# EasyEDA Pro project PRO_project.eprj, board PCB1_1 (continued)
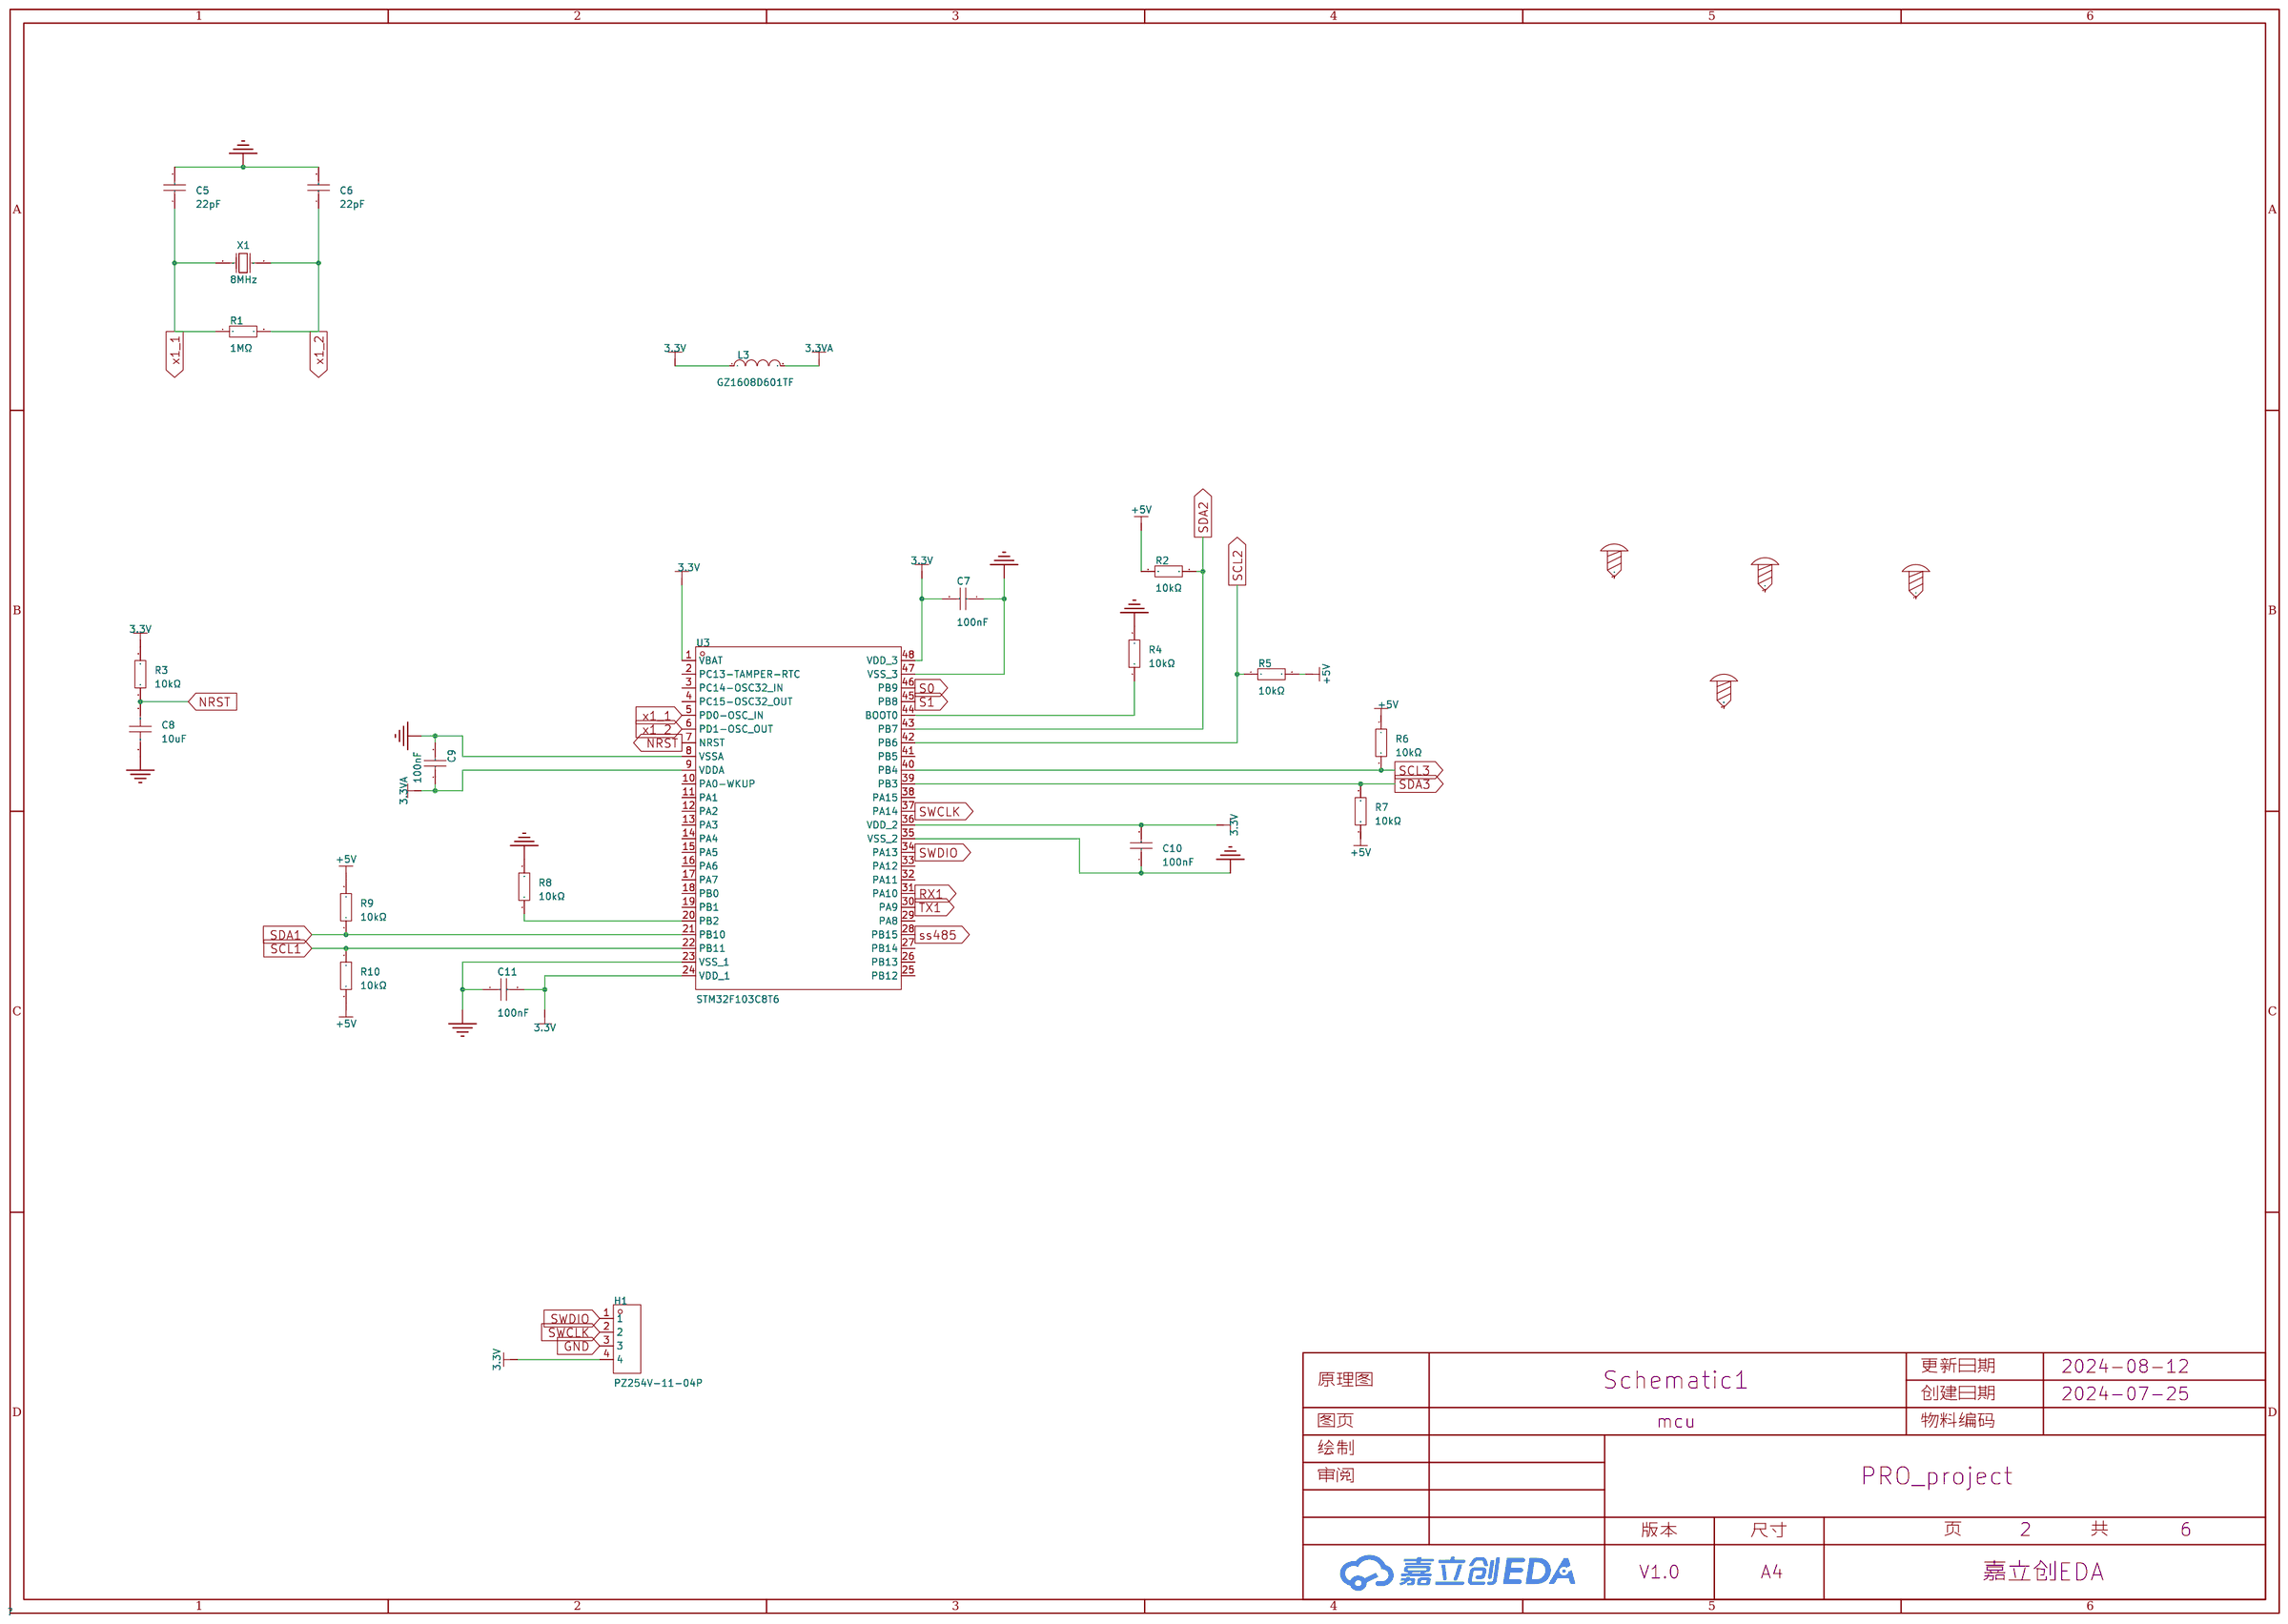
[diagram p0: mcu]
## Routing (per net, layer and track width the routed paths; a pad name or vN(x,y) marks a point on that pad's centre or on a via; arc(x,y) is an arc through that point) (continued)
  Top Layer w0.762: 29.47,14.94 L2.2 29.47,27.43 ; 29.47,14.94 29.47,9.52 30.08,8.91 v1(31.84,8.91) v1(32.82,8.91) ; 29.47,14.94 30.24,14.18 37.93,14.18 U34.2 ; 29.47,27.43 34.4,27.43 U2.3 ; 29.47,27.43 29.47,31.14 28.84,31.77 C3.1 27.2,33.87 25.42,35.65 15.18,35.65 U1.4 ; v1(3.86,52.98) 3.9,52.94 C20.2
  Inner2 w0.762: U9.2 33.47,59.42 46.32,59.42 U11.2 ; U19.2 103.51,59.55 91.17,59.55 U18.2 ; v1(39.33,50.83) 38.38,50.83 v1(34.64,47.09) 34.64,46.99 v1(32.69,45.04) ; U16.2 75.5,59.82 63.68,59.82 U17.2
  Bottom Layer w0.254: 102.99,50.29 115.29,50.29 v1(115.49,50.09) ; 102.99,50.29 103.03,50.25 v1(103.03,40.53) ; 102.99,50.29 83.41,50.29 82.73,49.61 v1(82.73,47.38) 82.69,47.38 82.66,47.35 ; v1(14.05,47.08) 14.1,47.03 14.17,47.03 14.17,52.34 v1(12.9,53.61) ; v1(115.49,42.32) 115.52,42.32 ; 32.79,45.24 v1(34.64,47.09) ; v1(71.06,51.47) 71.04,51.49 69.59,51.49 69.06,50.96 69.06,50.03 v1(69.16,49.93) 69.1,49.93
  Bottom Layer w0.508: v1(115.47,47.4) 115.49,47.38 v1(115.49,42.32)
  Bottom Layer w0.762: 67.63,27.99 67.84,27.78 U26.2 75.52,27.26 U25.2 102.64,27.26 U24.2 116.17,27.6 U27.2 ; 67.63,27.99 v1(67.63,29.17) ; 67.63,27.99 67.63,13.15 63.43,8.95 30.99,8.95 ; 2.14,53.01 2.14,57.71 3.18,58.75 U8.2 U10.2 U9.2 ; 2.14,53.01 2.17,52.98 v1(3.86,52.98) ; 2.14,53.01 2.14,49.8 15.03,36.91 22.06,36.91 C3.1 ; U16.2 U18.2 ; U11.2 U17.2
GND: length 621.3
  Top Layer w0.254: 106.1,46.46 106.1,48.32 v1(105.67,48.75) ; 106.1,46.46 U32.8 ; 106.1,46.46 U32.6 ; C44.1 102.53,33.75 U20.5 ; C48.2 11.27,49.45 v1(11.27,50.34) ; v1(41.93,34) 43.05,32.88 C11.1 43.74,33.32 43.74,33.71 44.11,34.08 44.11,34.11 ; 42.67,45.93 42.76,45.84 42.76,44.02 43.81,42.97 C9.2 ; 42.67,45.93 39.98,45.93 v1(38.99,46.91) C49.2 ; 42.67,45.93 44.44,47.7 ; v1(66.41,49.42) 67.21,48.62 C51.2 ; v1(97.92,41.48) 98.18,41.22 99.78,41.22 ; v1(27.2,37.31) 30.33,37.31 32.69,39.67 U29.2 ; v1(27.2,37.31) 26.28,37.31 23.13,40.46 U28.7 ; v1(27.2,37.31) 27.13,37.24 ; U23.5 115.78,33.14 C47.1 ; U38.3 61.68,12.67 61.64,12.71 v1(60.27,12.71) ; C50.2 87.67,46.61 v1(87.89,46.39) ; v1(51.58,43.87) 51.08,44.37 49.27,44.37 47.92,45.72 v1(47.92,46.4) 47.92,48.06 v1(48.74,48.88) 48.74,51.38 49.07,51.71 57.52,51.71 58.24,50.99 v1(58.24,47.21) 58.24,45.54 v1(57.26,44.56) 56.18,44.56 55.59,43.97 55.59,42.95 54.69,42.05 v1(54.25,42.05) ; C4.2 43.24,26.54 v1(43.87,25.91) ; R3.2 60.57,40.4 v1(60.33,40.64) 58.75,40.64 C7.1 ; C53.2 116.06,39.74 v1(115.37,39.06) ; C22.1 20.29,53.75 U6.5 ; v1(101.49,48.25) 101.07,47.83 U33.2 ; 44.44,47.7 43.75,47.7 42.92,48.53 v1(42.87,48.53) ; 44.44,47.7 C8.1 ; v1(48.03,43.59) 48.03,43.42 48.38,43.07 50.54,43.07 51.82,41.79 U3.8 51.82,39.35 52.4,38.77 56.81,38.77 U3.47 ; U22.5 74.46,33.65 C45.1 ; C35.1 105.79,54 U15.5 ; C46.1 87.71,33.08 U21.5 ; C21.1 35.31,55.86 U5.5 ; C23.1 46.4,51.96 45.2,50.76 v1(43.56,50.76) ; U13.5 65.5,56.54 C33.1 61.95,52.88 v1(61.95,50.6) ; U28.8 24.28,42.71 22.18,42.71 ; U31.2 85.08,40.63 84.9,40.45 81.01,40.45 v1(79.99,41.47) 79.36,42.1 U30.8 U30.7 U30.6 ; 2.21,50.36 2.23,50.34 v1(6.99,50.34) ; U3.23 53.57,34.27 53.57,34.28 v1(54.81,34.28) 54.81,33.38 54.82,33.38 U3.35 ; H2.3 62.27,32.33 62.09,32.52
  Top Layer w0.508: C47.1 116.62,33.12 U27.1 ; U13.5 64.95,56.21 U17.1 ; U11.1 49.47,56.21 U7.5 ; U25.1 89.52,30.06 C46.1 ; U14.5 91.96,56.21 U18.1 ; U24.1 102.72,30.4 C44.1 ; U5.5 35.16,56.21 U9.1 ; U10.1 21.23,56.21 U6.5 ; U4.5 7.87,56.21 U8.1 ; U12.5 79.04,56.21 76.68,56.21 ; U19.1 106.46,56.21 U15.5 ; C45.1 74.92,30.4 U26.1
  Top Layer w0.762: v1(53.42,51.77) 53.42,50.54 53.17,50.29 ; 53.17,50.29 54.55,50.29 C5.2 ; 53.17,50.29 C6.2 ; U1.6 4.84,33.75 C1.2 ; U1.6 2.21,36.38 2.21,55.17 3.25,56.21 U8.1 ; U1.6 v1(8.15,37.24) U1.5 27.17,37.24 32.5,31.91 U2.1 ; U1.6 v1(8.5,33.84) U1.3 ; C54.2 37.03,12.54 U34.1 ; C32.1 77.77,53.41 77.77,55.12 76.68,56.21 U16.1 ; CN1.2 13.7,11.19 D2.1 ; 13.39,10.98 D2.1 ; D2.1 15.36,11.24 16.34,12.22 D3.1 ; U18.1 91.31,55.27 91.31,53.8 C34.1
  Inner1 w0.762: U26.1 77.21,32.53 86.53,32.53 U25.1 91.08,31.62 101.5,31.62 U24.1 104.73,31.89 115.24,31.89 116.62,30.51 U27.1 120.11,33.18 v1(120.11,33.49) v1(120.11,42.54) 120.11,50.22 v1(118.09,52.24) 114.12,56.21 U19.1 102.16,54.06 92.52,54.06 U18.1 86.72,52.56 80.22,52.56 U16.1 73.4,53.04 65.78,53.04 U17.1 61.56,55.16 48.04,55.16 U11.1 44.83,54.05 43.53,54.05 41.37,56.21 U9.1 30.99,54.4 20.91,54.4 U10.1 19.01,56.3 10.4,56.3 8.46,54.36 7.31,54.36 U8.1 5.46,39.93 v1(8.15,37.24) 8.15,29.21 v1(7.95,29.01) 7.95,22.75 C1.2 4.84,12.92 CN1.2
  Bottom Layer w0.254: v1(105.67,48.75) 105.62,48.75 105.58,48.71 ; v1(115.37,39.06) 115.37,39.07 ; v1(43.56,50.76) 42.92,50.12 42.92,48.6 42.87,48.55 v1(42.87,48.53) 43.48,48.53 48.03,43.98 v1(48.03,43.59) ; v1(66.41,49.42) 66.39,49.44 ; v1(87.89,46.39) 87.88,46.39 ; v1(11.27,50.34) v1(6.99,50.34)
  Bottom Layer w0.762: U26.1 71.22,30.32 v1(68.45,33.09) ; v1(61.95,50.6) 62.61,51.26 U17.1
  vias: v1(1.18,29.01) v1(1.53,38.14) v1(10.46,51.99) v1(32.44,49) v1(59.27,22.33) v1(59.89,18.39) v1(60.57,28.37) v1(80.03,33.54) v1(90.39,36.01) v1(101.19,44.23) v1(111.18,43.17) v1(113.64,52.24) v1(120.16,36.64) v1(120.28,47.19)
1N0: length 35.3
  Top Layer w0.254: 15.51,42.59 15.51,44.36 v1(15.4,44.47) ; 36.78,55.86 36.78,54 36.63,53.86 v1(36.56,53.86)
  Bottom Layer w0.254: v1(15.4,44.47) 15.35,44.47 15.35,53.93 15.92,54.5 35.92,54.5 v1(36.56,53.86)
1N1: length 25.5
  Top Layer w0.254: v1(23.35,53.51) 23.35,55.35 U6.6 ; v1(20.64,39.98) 20.62,39.98 20.62,42.56 20.59,42.59
  Bottom Layer w0.254: v1(23.35,53.51) 22.86,53.02 19.47,53.02 17.82,51.37 17.82,40.41 18.91,39.32 19.98,39.32 v1(20.64,39.98)
1N2: length 18.3
  Top Layer w0.254: 9.2,56.15 9.2,49.75 13.31,45.64 15.98,45.64 16.78,44.84 U28.2
1N3: length 46.6
  Top Layer w0.254: U7.6 50.96,55.36 v1(49.15,53.56) ; v1(19.29,40.57) 19.32,40.59 U28.4
  Bottom Layer w0.254: v1(49.15,53.56) 47.28,51.69 19.98,51.69 19.29,51 v1(19.29,40.57)
1P0: length 23.6
  Top Layer w0.254: 20.59,48.06 20.59,49.98 21.6,51 36.22,51 38.07,52.85 38.07,55.83 U5.7
1P1: length 13.1
  Top Layer w0.254: U6.7 24.6,55.37 24.6,52 24.35,51.75 19.34,51.75 18.05,50.45 U28.14
1P2: length 11.8
  Top Layer w0.254: U4.7 10.47,53.97 14.31,50.13 16.24,50.13 16.78,49.59 U28.15
1P3: length 34.7
  Top Layer w0.254: U7.7 52.23,55.63 46.48,49.89 22.18,49.89 21.86,49.56 U28.11
1ZN: length 17.5
  Top Layer w0.254: U28.3 18.05,44 18.36,44.32 28.98,44.32 29.73,43.57 29.73,42.07 30.81,40.99 U29.1
1ZP: length 16
  Top Layer w0.254: U28.13 19.32,46.04 19.97,45.39 31,45.39 31.74,44.65 U29.6
2N0: length 40
  Top Layer w0.254: U30.1 68.83,42.1 v1(67.9,43.03) ; U14.6 94.67,54.76 94.67,52.98 94.19,52.5 v1(93.54,52.5)
  Bottom Layer w0.254: v1(67.9,43.03) 67.9,51.7 68.7,52.5 v1(93.54,52.5)
2N1: length 43.5
  Top Layer w0.254: v1(74.62,39.46) 74.59,39.49 U30.5 ; U12.6 80.77,54.16 v1(80.64,54.04)
  Bottom Layer w0.254: v1(80.64,54.04) 65.14,54.04 64.02,52.92 64.02,43.61 68.57,39.06 74.22,39.06 v1(74.62,39.46)
2N2: length 19.6
  Top Layer w0.254: U13.6 66.77,52.44 65.1,50.78 65.1,46.6 66.15,45.55 69.44,45.55 70.7,44.29 70.7,42.18 U30.2
2N3: length 50.2
  Top Layer w0.254: v1(73.27,40.29) 73.32,40.33 U30.4 ; v1(108.43,53.01) 108.38,53.06 108.38,55.32 U15.6
  Bottom Layer w0.254: v1(108.43,53.01) 107.1,51.67 75.29,51.67 73.27,49.66 v1(73.27,40.29)
2P0: length 27.4
  Top Layer w0.254: U14.7 95.67,54.88 95.67,51.53 95.1,50.96 75.9,50.96 74.59,49.64 U30.12
2P1: length 16.5
  Top Layer w0.254: U30.14 72.05,50.47 73.21,51.64 80.31,51.64 82.04,53.36 82.04,55.75
2P2: length 10.3
  Top Layer w0.254: 68.04,56.75 68.04,52.92 70.78,50.18 U30.15
2P3: length 40.8
  Top Layer w0.254: U30.11 75.86,49.48 76.73,50.36 109.04,50.36 109.74,51.06 109.74,55.41 U15.7
2ZN: length 14.4
  Top Layer w0.254: U31.1 84.09,42.58 84.09,43.21 83.54,43.76 72.49,43.76 72.05,43.31 U30.3
2ZP: length 13.1
  Top Layer w0.254: U31.6 83.55,44.66 74.81,44.66 73.32,46.15 U30.13
3N0: length 42.8
  Top Layer w0.254: U21.6 84.64,31.45 v1(84.64,33.61) ; v1(114.2,44.72) 113.72,45.2 U32.1
  Bottom Layer w0.254: v1(114.2,44.72) 114.2,37.16 111.18,34.14 85.17,34.14 v1(84.64,33.61)
3N1: length 26.9
  Top Layer w0.254: v1(108.62,48.64) 108.64,48.62 U32.5 ; U20.6 98.75,31.27 98.75,33.36 98.72,33.36 99.8,34.44 v1(99.8,35.33)
  Bottom Layer w0.254: v1(99.8,35.33) 100.99,36.52 106.54,36.52 108.59,38.57 108.59,48.61 v1(108.62,48.64)
3N2: length 21.7
  Top Layer w0.254: U32.2 112.45,44.11 112.7,43.86 116.67,43.86 117.3,43.23 117.3,38.65 112.44,33.78 U23.6
3N3: length 76.1
  Top Layer w0.254: U22.6 70.8,31.35 v1(70.8,33.89) ; v1(109.88,48.84) 109.91,48.81 U32.4
  Bottom Layer w0.254: v1(109.88,48.84) 110.28,49.24 117.29,49.24 118.49,48.04 118.49,36.07 114.73,32.31 72.38,32.31 v1(70.8,33.89)
3P0: length 32.3
  Top Layer w0.254: U21.7 83.46,34.05 83.75,34.35 93.41,34.35 95.65,36.59 106.85,36.59 108.64,38.37 U32.12
3P1: length 21.9
  Top Layer w0.254: U32.14 111.18,37.95 109.14,35.91 98.01,35.91 97.5,35.4 U20.7
3P2: length 10.5
  Top Layer w0.254: U32.15 112.54,40.9 112.54,36.61 111.17,35.23 U23.7
3P3: length 45.5
  Top Layer w0.254: U32.11 107.37,38.34 106.36,37.34 88.38,37.34 86.55,35.51 70.18,35.51 69.58,34.9 U22.7
3ZN: length 11.4
  Top Layer w0.254: U32.3 111.18,44.75 110.95,44.53 103.07,44.53 U33.1
3ZP: length 9.7
  Top Layer w0.254: U33.6 109.63,42.88 109.97,42.54 109.97,41.06 U32.13
485+: length 56.9
  Top Layer w0.254: v1(52.27,11.61) 51.24,12.64 51.19,12.64 R63.2 ; R58.2 35.51,22.62 34.53,23.6 v1(34.51,23.6) ; 42.53,17.54 41.1,17.54 40.55,16.99 R57.1 40.33,16.58 38.07,16.58
  Top Layer w0.381: U37.4 56.7,18.07 57.53,17.24 57.53,10.7 56.96,10.13 53.75,10.13 v1(52.27,11.61)
  Top Layer w0.762: 38.07,16.58 37.99,16.5 31.51,16.5
  Bottom Layer w0.254: 37.36,16.5 34.51,19.35 v1(34.51,23.6) ; 38.07,16.58 39.77,14.88 49,14.88 v1(52.27,11.61)
485-: length 67
  Top Layer w0.254: 38.07,19.12 40.31,21.35 42.53,21.35 ; v1(45.52,25.11) 45.52,27.35 45.69,27.52 47.78,27.52 U36.3 ; R60.1 33.19,24.79 32.45,24.05 32.45,19.4 32.73,19.12
  Top Layer w0.381: v1(50.12,10.46) 49.44,11.14 R55.2
  Top Layer w0.762: 31.51,17.9 32.73,19.12 38.07,19.12
  Bottom Layer w0.254: v1(45.52,25.11) 40.72,25.11 38.07,22.46 38.07,19.12
  Bottom Layer w0.381: v1(50.12,10.46) 50.12,10.49 53.73,10.49 54.7,11.46 54.7,22.18 52.68,24.2 46.43,24.2 v1(45.52,25.11)
DI: length 13.4
  Top Layer w0.254: 47.47,22.62 47.79,22.94 U36.4 ; 47.47,22.62 R58.1 ; 47.47,22.62 47.94,22.15 U35.4
NRST: length 10.6
  Top Layer w0.254: C8.2 46.68,46.32 R2.1 46.83,46.05 49.31,43.57 50.75,43.57 52.32,42 U3.7
RO: length 14.5
  Top Layer w0.254: U35.1 50.04,17.54 51.03,16.55 56,16.55 56.51,16.04 56.51,13.25 55.93,12.67 U38.2
RX1: length 59.3
  Top Layer w0.254: v1(59.63,25.38) 59.63,27.62 58.55,28.7 v1(54.53,28.7) 52.82,30.41 U3.31 ; v1(65.03,25.59) 65.03,25.52 ; 65.03,25.52 R62.2 ; 65.03,25.52 65.88,24.67 65.88,16.22 64.87,15.21 U38.4
  Bottom Layer w0.254: v1(65.03,25.59) 59.84,25.59 v1(59.63,25.38) ; H4.1 33.3,31.46 36.78,27.98 53.81,27.98 v1(54.53,28.7)
S0: length 153.2
  Top Layer w0.254: v1(91.57,47.79) 91.57,49.5 91.43,49.64 77.54,49.64 77.13,49.22 U30.10 77.1,47.55 v1(77.1,45.82) ; v1(46.46,41.05) 43.6,41.05 39.12,45.53 34.7,45.53 33.99,46.24 23.61,46.24 23.13,46.72 U28.10 ; v1(91.08,40.68) 91.13,40.63 91.13,39.32 92.32,38.13 105.39,38.13 106.1,38.83 106.1,40.99 ; v1(50.98,38.59) 51.3,38.27 U3.46 57.86,38.27 v1(58.58,38.99)
  Inner1 w0.254: v1(58.58,38.99) 69.09,38.99 73.55,43.45 90.41,43.45 91.5,44.54 H3.1
  Inner2 w0.762: v1(46.46,41.05) 46.46,40.66 47.7,39.42 50.15,39.42 v1(50.98,38.59)
  Bottom Layer w0.254: v1(91.57,47.79) 91.08,47.3 v1(91.08,40.68) ; v1(58.58,38.99) 65.84,38.99 67.82,37.01 76.04,37.01 77.1,38.07 v1(77.1,45.82)
S1: length 123.4
  Top Layer w0.254: U30.9 78.4,48.57 78.58,48.76 88.84,48.76 89.62,47.98 89.62,45.87 90,45.49 93.98,45.49 94.15,45.32 ; U28.9 39.73,48.06 v1(40.46,47.33) ; v1(94.18,40.9) 96.13,38.95 104.47,38.95 104.83,39.3 U32.9 ; v1(94.18,45.49) 94.18,47.58 H3.2 ; v1(50.39,37.77) U3.45 58.74,37.77 v1(59.12,38.15)
  Inner1 w0.254: H3.2 94.04,43.93 92.74,42.63 89.73,42.63 83.8,36.7 60.57,36.7 v1(59.12,38.15)
  Inner2 w0.762: v1(50.39,37.77) 46.14,37.77 40.46,43.45 v1(40.46,47.33)
  Bottom Layer w0.254: v1(94.18,40.9) v1(94.18,45.49)
SCL1: length 88.7
  Top Layer w0.254: v1(42.52,36.55) 38.08,40.99 U29.3 ; U33.3 100.12,46.54 v1(99.12,47.54) 98.82,47.84 H1.1 ; v1(86.07,40.21) 86.03,40.25 U31.3 ; v1(51.71,35.56) 52.42,36.27 U3.42 60.52,36.27 61,35.79 61.7,35.79 R5.1 62.47,36.56 v1(85.18,36.56)
  Inner2 w0.762: v1(42.52,36.55) 43.51,35.56 v1(51.71,35.56)
  Bottom Layer w0.254: v1(99.12,47.54) 99.12,48.35 97.9,49.57 86.64,49.57 86.07,49 v1(86.07,40.21) 86.07,37.45 v1(85.18,36.56)
SDA1: length 81.1
  Top Layer w0.254: 88.77,43.21 89.1,42.88 97.32,42.88 ; 88.77,43.21 88.77,39.52 86.8,37.55 R4.2 61.19,36.77 U3.43 v1(50.46,36.77) ; 88.77,43.21 v1(88.77,44.55) 88.1,45.22 86.05,45.22 U31.4 ; 97.32,42.88 U33.4 ; 97.32,42.88 97.32,45.21 H1.2 ; U29.4 37.88,43.69 v1(41.53,40.04)
  Inner2 w0.762: v1(50.46,36.77) 44.8,36.77 v1(41.53,40.04)
SS: length 22.4
  Top Layer w0.254: R60.2 44.16,24.79 v1(45.3,23.65) ; U35.3 U35.2 46.23,18.81 v1(45.91,19.13) ; 53.56,20.08 U37.3
  Top Layer w0.381: U35.3 53.56,20.08
  Bottom Layer w0.254: v1(45.91,19.13) 45.91,19.17 45.3,19.78 v1(45.3,23.65)
SS485: length 36.9
  Top Layer w0.254: U37.2 57.24,20.61 51.32,26.53 v1(51.32,30.38) U3.28
  Bottom Layer w0.254: H4.3 38.55,35.57 38.55,32.42 40.59,30.38 v1(51.32,30.38)
SWCLK: length 5.6
  Top Layer w0.254: H2.2 59.75,30.36 59.75,32.51 58.49,33.77 U3.37
SWDIO: length 4.6
  Top Layer w0.254: 57.14,30.12 57.01,30.25 54.84,30.25 54.32,30.77 U3.34
TX1: length 29.7
  Top Layer w0.254: U3.30 52.32,29.54 v1(52.78,29.08) 54.35,27.51 U36.2
  Bottom Layer w0.254: v1(52.78,29.08) 38.91,29.08 36.3,31.69 36.3,35.28 H4.2
X1_1: length 10.9
  Top Layer w0.254: 56.51,50.39 56.51,47.44 X1.2 54.39,45.32 R1.1 53.32,42.16 U3.5
X1_2: length 10.5
  Top Layer w0.254: 49.9,50.04 49.9,47.13 X1.1 52.89,44.15 R1.2 52.82,43.17 U3.6
$1N1353: length 4.6
  Top Layer w0.254: U3.44 60.08,37.27 60.57,37.75 R3.1
$1N1456: length 4.5
  Top Layer w0.254: U3.20 46.94,35.77 46.7,35.53 46.7,34.76 46.22,34.28 45.14,34.28 R6.2
$2N657: length 14.3
  Top Layer w0.762: U1.2 17.54,32.14 19.14,30.54 19.14,26.83 19.09,26.78 19.21,26.66 ; 19.21,26.66 16.81,26.66 D3.2 ; 19.21,26.66 L1.2
$2N1653: length 14.3
  Top Layer w0.762: L2.1 26.87,21.07 25.86,20.06 L1.1 21.75,16 22.25,15.5 24.24,15.5 C2.1
$2N2288: length 10.9
  Top Layer w0.762: CN1.1 18.83,4.19 D2.2 18.91,11.31 D1.2
$2N2289: length 21.7
  Top Layer w0.762: D1.1 9.84,18.77 C1.1 11.7,19.64 12.47,20.41 12.47,29.94 12.97,30.44 U1.1
$3N444: length 5.4
  Top Layer w0.762: R18.1 40.15,71.19 R17.1
$3N877: length 14.7
  Top Layer w0.254: U5.4 35.45,66.81 35.45,67.95 35.06,68.34 C17.1 31.02,68.34 30.76,68.08 30.76,61.8 31.26,61.3 32.79,61.3 U9.3
$3N883: length 11.9
  Top Layer w0.254: C17.2 32.18,64.45 U9.4 34.09,65.12 39.04,65.12 39.32,65.39 U5.1
$3N1473: length 7
  Top Layer w0.762: CN4.1 22.95,81.72 R11.2
$3N1476: length 6.7
  Top Layer w0.762: CN4.2 28.35,82.12 R12.2
$3N1479: length 5.5
  Top Layer w0.762: R20.1 28.15,71.03 R19.1
$3N1489: length 16.8
  Top Layer w0.254: U6.3 23.26,68.55 22.64,69.17 21.63,69.17 20.05,70.75 20.05,74.29 20.49,74.73 R11.1
  Top Layer w0.762: 22.95,74.07 23,74.03 C14.1 ; 22.95,74.07 R19.2 ; 22.95,74.07 R11.1
$3N1497: length 17.9
  Top Layer w0.254: 28.35,74.03 29.82,74.03 30.27,73.58 30.27,70.07 29.05,68.85 24.74,68.85 24.53,68.63 U6.2
  Top Layer w0.762: 28.35,74.07 R20.2 ; 28.35,74.07 28.31,74.03 C14.2 ; 28.35,74.07 R12.1
$3N1505: length 15.7
  Top Layer w0.254: U6.4 22.02,66.38 22.02,67.26 20.91,68.37 C18.1 16.72,68.37 16.2,67.85 16.2,63.26 18.05,61.41 18.98,61.41 U10.3
$3N1512: length 12.5
  Top Layer w0.254: C18.2 17.78,66.83 17.78,64.45 18.4,63.83 U10.4 20.09,63.83 21.01,64.75 25.23,64.75 25.8,65.31 U6.1
$3N1940: length 8.9
  Top Layer w0.762: R7.2 7.76,77 CN2.1
$3N1943: length 8.7
  Top Layer w0.762: R8.2 18.83,82.24 CN2.2
$3N1946: length 5.6
  Top Layer w0.762: R15.1 R16.1
$3N1956: length 14.7
  Top Layer w0.254: 9.2,67.05 9.2,68.35 8.6,68.95 6.53,68.95 5.76,69.72 5.76,72.89 6.64,73.77 7.76,73.77
  Top Layer w0.762: 7.76,73.77 R15.2 ; 7.76,73.77 R7.1 ; 7.76,73.77 9.76,73.77 C12.1
$3N1964: length 15.3
  Top Layer w0.254: 13.36,73.67 13.82,73.21 14.81,73.21 14.96,73.06 14.96,69.59 14.36,68.99 11.44,68.99 10.47,68.01 U4.2
  Top Layer w0.762: 13.36,73.67 R16.2 ; 13.36,73.67 13.36,73.67 C12.2 ; 13.36,73.67 13.36,74.57 R8.1
$3N1972: length 13.8
  Top Layer w0.254: U8.3 2.4,64.35 2.4,67.54 3.1,68.24 C16.1 5.54,68.24 6.5,67.28 7.7,67.28 U4.4
$3N1979: length 12.5
  Top Layer w0.254: C16.2 4.11,65.18 U8.4 5.46,64.67 6.21,65.42 11.51,65.42 11.74,65.64 U4.1
$3N2407: length 8.5
  Top Layer w0.762: CN5.1 45.56,78.92 47.24,77.24 48.6,77.24 R13.2
$3N2410: length 8.1
  Top Layer w0.762: CN5.2 54.55,79.3 R14.2
$3N2413: length 5.7
  Top Layer w0.762: R21.1 R22.1
$3N2423: length 14.9
  Top Layer w0.254: R21.2 47.19,73.19 47,73 47,69.99 47.67,69.32 49.81,69.32 50.96,68.17 U7.3
  Top Layer w0.762: 48.85,74.01 50.73,74.01 C15.1 ; 48.85,74.01 R13.1 ; 48.85,74.01 R21.2
$3N2431: length 16
  Top Layer w0.254: U7.2 52.23,68.56 52.55,68.89 55.86,68.89 56.26,69.29 56.26,73.31 55.63,73.94 54.55,73.94
  Top Layer w0.762: C15.2 54.4,73.79 54.55,73.94 ; R22.2 54.55,73.94 ; 54.55,73.94 R14.1
$3N11930: length 7.2
  Top Layer w0.762: CN6.1 105.34,81.02 R29.2
$3N11931: length 5.3
  Top Layer w0.762: R36.1 96.54,71.04 R35.1
$3N11934: length 17.4
  Top Layer w0.254: R35.2 90.81,73.57 89.92,73.57 89.05,72.7 89.05,70.87 90.16,69.76 92.99,69.76 94.48,68.27 U14.3
  Top Layer w0.762: C26.1 93.12,73.96 91.34,73.96 ; 91.34,73.96 91.34,74.74 R27.1 ; 91.34,73.96 R35.2
$3N11935: length 17.6
  Top Layer w0.254: U14.2 95.75,68.64 96.49,69.39 98.34,69.39 99.41,70.46 99.41,73.64 98.58,74.47 97.11,74.47 R28.1
  Top Layer w0.762: 96.64,74.02 96.46,73.84 C26.2 ; 96.64,74.02 R36.2 ; 96.64,74.02 R28.1
$3N11945: length 12.1
  Top Layer w0.762: CN9.1 66.66,83.11 64.47,80.92 64.47,77.17 R25.2
$3N11946: length 5.3
  Top Layer w0.762: R32.1 82.94,71.24 R31.1
$3N11949: length 17.6
  Top Layer w0.254: U12.3 80.77,68.24 79.12,69.89 75.99,69.89 75.35,70.53 75.35,73.51 75.61,73.77 77.41,73.77 R31.2
  Top Layer w0.762: 77.94,73.93 79.75,73.93 C24.1 ; 77.94,73.93 R23.1 ; 77.94,73.93 R31.2
$3N11950: length 14.8
  Top Layer w0.254: 82.04,66.65 82.04,68.25 82.84,69.06 84.51,69.06 85.34,69.89 85.34,72.77 84.27,73.84 83.14,73.84
  Top Layer w0.762: C24.2 83.08,73.84 83.14,73.9 ; 83.14,73.9 R32.2 ; 83.14,73.9 R24.1
$3N11960: length 8.3
  Top Layer w0.762: R23.2 78.78,77.04 82.21,80.47 CN7.1
$3N11961: length 5.4
  Top Layer w0.762: R34.1 69.74,71.14 R33.1
$3N11964: length 15.7
  Top Layer w0.254: 64.44,74.06 63.26,74.06 62.02,72.83 62.02,70.79 63.33,69.48 66.2,69.48 66.77,68.91 U13.3
  Top Layer w0.762: 64.44,74.06 64.77,73.74 C25.1 ; 64.44,74.06 64.44,74.94 R25.1 ; 64.44,74.06 R33.2
$3N11965: length 15.9
  Top Layer w0.254: 68.04,67.65 68.04,69.21 68.47,69.65 71.52,69.65 72.18,70.31 72.18,73.36 71.48,74.06 69.84,74.06
  Top Layer w0.762: R26.1 R34.2 69.34,73.74 C25.2
$3N11974: length 5.8
  Top Layer w0.762: R37.1 111.05,71.14 R38.1
$3N11977: length 17.2
  Top Layer w0.254: U15.3 108.5,67.79 106.54,69.75 103.65,69.75 103.16,70.24 103.16,73.47 103.63,73.94 105.34,73.94
  Top Layer w0.762: R29.1 105.34,74.02 ; 105.34,74.02 R37.2 ; 105.34,74.02 105.42,73.94 C27.1
$3N11978: length 17.1
  Top Layer w0.254: U15.2 109.77,68.84 109.91,68.99 112.64,68.99 113.5,69.85 113.5,73.74 113.35,73.89 111.11,73.89
  Top Layer w0.762: 111.11,73.89 111.06,73.94 C27.2 ; 111.11,73.89 111.11,74.77 R30.1 ; 111.11,73.89 R38.2
$3N13638: length 6.7
  Top Layer w0.762: 87.29,3.95 87.1,4.14 R41.2
$3N13639: length 5.4
  Top Layer w0.762: R49.1 86.8,16.1 R50.1
$3N13642: length 16.2
  Top Layer w0.254: 87.1,13.52 88.87,13.52 89.18,13.83 89.18,17.44 88.68,17.94 85.56,17.94 84.76,18.74 84.76,20.43 U21.3
  Top Layer w0.762: R41.1 87.1,13.52 ; 87.1,13.52 R49.2 ; 87.1,13.52 87.08,13.5 C37.1
$3N13643: length 15
  Top Layer w0.254: U21.2 83.46,19.44 82.02,18.01 80.99,18.01 79.77,16.79 79.77,13.52 80.23,13.06 82.19,13.06 82.44,13.31
  Top Layer w0.762: C37.2 83.61,13.31 82.44,13.31 ; R50.2 81.8,13.31 ; 81.8,13.06 R42.1
$3N13644: length 17.6
  Top Layer w0.254: U21.4 87.6,18.87 89.02,18.87 90.23,17.66 90.23,17.65 C41.1 92.71,17.65 93.04,17.98 93.04,22.46 90.78,24.72 U25.3
$3N13645: length 13.7
  Top Layer w0.254: C41.2 91.47,21.83 91.12,22.18 U25.4 89.17,22.09 82.53,22.09 82.19,21.74 U21.1
$3N13653: length 7.2
  Top Layer w0.762: R39.2 97.84,7.95 CN10.1
$3N13654: length 5.3
  Top Layer w0.762: R47.1 R48.1
$3N13657: length 15
  Top Layer w0.254: 99.99,13.67 101.58,13.67 102.03,14.12 102.03,17.5 101.66,17.87 99.47,17.87 98.77,18.57 98.77,20.35 U20.3
  Top Layer w0.762: 100.16,13.5 100.16,12.27 R39.1 ; 100.16,13.5 99.99,13.67 C36.1 ; 100.16,13.5 R47.2
$3N13658: length 15.5
  Top Layer w0.254: U20.2 97.5,18.54 97.09,18.14 94.42,18.14 93.13,16.85 93.13,14.32 93.68,13.77 94.56,13.77 R48.2
  Top Layer w0.762: C36.2 96.46,14.07 R48.2 R40.1
$3N13659: length 15.3
  Top Layer w0.254: U24.3 103.85,25.06 105.96,22.95 105.96,18.65 105.3,17.99 C40.1 103.02,17.99 100.65,20.36 U20.4
$3N13660: length 12
  Top Layer w0.254: U20.1 96.23,21.47 96.65,21.9 102.36,21.9 U24.4 104.32,21.18 C40.2
$3N13668: length 11
  Top Layer w0.762: CN11.1 111.8,3.91 113.67,5.78 113.67,10.48 R45.2
$3N13669: length 5.2
  Top Layer w0.762: R53.1 113.7,16.24 R54.1
$3N13672: length 13.6
  Top Layer w0.254: U23.3 112.44,18.75 112.69,18.5 113.96,18.5 115.51,16.95 115.51,14.38 114.63,13.5 113.71,13.5
  Top Layer w0.762: C39.1 113.57,13.64 113.71,13.5 ; R53.2 113.71,13.5 ; 113.71,13.5 113.71,12.56 R45.1
$3N13673: length 15.3
  Top Layer w0.254: 108.53,13.66 107.5,13.66 106.45,14.71 106.45,16.98 107.37,17.9 110.15,17.9 111.17,18.91 U23.2
  Top Layer w0.762: R54.2 108.53,13.66 ; 108.53,13.66 R46.1 ; 108.53,13.66 110.41,13.66 C39.2
$3N13674: length 16.2
  Top Layer w0.254: U23.4 116.38,17.5 C43.1 119.95,17.5 120.33,17.88 120.33,20.9 U27.3
$3N13675: length 12
  Top Layer w0.254: U23.1 109.9,21.14 110.31,21.56 116.11,21.56 U27.4 118.44,20.25 C43.2
$3N13681: length 6.8
  Top Layer w0.762: CN13.1 75.17,5.51 R43.2
$3N13682: length 5.4
  Top Layer w0.762: R52.1 74.88,16.01 R51.1
$3N13685: length 17.6
  Top Layer w0.254: U22.3 70.85,18.32 71.1,18.07 75.36,18.07 76.71,16.72 76.71,13.46 76.22,12.97 75.07,12.97
  Top Layer w0.762: R43.1 75.07,12.12 R51.2 74.75,13.51 C38.1
$3N13686: length 13.5
  Top Layer w0.254: R52.2 68.59,14.01 67.46,15.14 67.46,17.34 68.1,17.98 69.02,17.98 69.58,18.53 U22.2
  Top Layer w0.762: C38.2 71.24,14.01 R52.2 69.74,12.3 R44.1
$3N13687: length 17.7
  Top Layer w0.254: U26.3 76.5,25.24 79.39,22.35 79.39,18.83 78.74,18.18 C42.1 77.69,18.07 76.82,18.07 75.92,18.97 73.56,18.97 U22.4
$3N13688: length 13.2
  Top Layer w0.254: C42.2 77.8,21.14 76.45,22.49 75.21,22.49 U26.4 74.05,21.75 68.71,21.75 68.31,21.34 U22.1
$3N18144: length 17.6
  Top Layer w0.254: U18.3 88.29,61.29 87.08,62.5 87.08,68.02 87.56,68.5 C30.1 92.05,68.5 93.21,67.34 U14.4
$3N18145: length 12.6
  Top Layer w0.254: C30.2 88.85,64.61 89.55,63.91 90.29,63.91 U18.4 96.34,63.83 97.02,64.5 U14.1
$3N18189: length 15.8
  Top Layer w0.254: U12.4 79.5,67.71 78.63,68.58 C28.1 74.77,68.58 73.74,67.55 73.74,62.87 75.32,61.29 U16.3
$3N18190: length 12.1
  Top Layer w0.254: U12.1 83.31,65.75 82.63,65.08 78.79,65.08 77.54,63.83 U16.4 75.73,64.67 C28.2
$3N18234: length 15.5
  Top Layer w0.254: U17.3 60.64,61.29 59.75,62.18 59.75,68.22 60.01,68.47 C29.1 64.67,68.47 U13.4
$3N18235: length 14.1
  Top Layer w0.254: U13.1 69.31,66.49 69.05,66.24 64.05,66.24 62.61,64.8 U17.4 61.44,63.83 61.15,64.12 C29.2
$3N18279: length 16.8
  Top Layer w0.254: U19.3 102.4,61.29 100.76,62.93 100.76,67.94 101.32,68.5 C31.1 104.08,68.5 106.24,66.34 U15.4
$3N18280: length 13.3
  Top Layer w0.254: C31.2 102.33,64.66 103.16,63.83 U19.4 105.39,63.83 106.3,64.74 110.71,64.74 111.07,65.1 111.07,66.3 U15.1
$3N18687: length 15.6
  Top Layer w0.254: U11.3 45.57,61.29 44.31,62.55 44.31,68.15 44.52,68.36 C19.1 49.37,68.36 49.68,68.05 49.68,66.89 U7.4
$3N18688: length 12.7
  Top Layer w0.254: U7.1 53.5,65.65 53.02,65.18 48.67,65.18 47.32,63.83 U11.4 46.02,63.83 45.7,64.15 C19.2
$3N20010: length 16
  Top Layer w0.254: 34.85,74.14 33.42,74.14 32.51,73.23 32.51,70.86 34.15,69.22 36.28,69.22 36.78,68.72 36.78,66.76
  Top Layer w0.762: 34.85,74.14 R17.2 ; 34.85,74.14 36.7,74.14 C13.2 ; 34.85,74.14 R9.1
$3N20027: length 16.1
  Top Layer w0.254: 40.25,73.99 41.78,73.99 42.05,73.72 42.05,69.62 41.31,68.88 38.37,68.88 38.05,68.55 U5.2
  Top Layer w0.762: 40.25,73.87 R10.1 ; 40.25,73.87 R18.2 ; 40.25,73.87 40.13,73.99 C13.1
$3N20036: length 6.4
  Top Layer w0.762: CN3.1 34.85,83.09 R9.2
$3N20045: length 6.5
  Top Layer w0.762: CN3.2 40.25,82.99 R10.2
$3N20240: length 6.9
  Top Layer w0.762: CN8.1 91.24,81.64 R27.2
$3N20244: length 6.6
  Top Layer w0.762: R28.2 96.64,82.04 CN8.2
$3N20274: length 9.3
  Top Layer w0.762: R24.2 85.47,76.84 87.07,78.44 87.07,82.97 CN7.2
$3N20282: length 11.4
  Top Layer w0.762: R26.2 73.87,76.94 76.71,79.78 CN9.2
$3N20291: length 7.5
  Top Layer w0.762: R30.2 111.04,80.32 108.19,83.17
$3N20301: length 7.3
  Top Layer w0.762: CN13.2 69.67,6.01 R44.2
$3N20311: length 6.6
  Top Layer w0.762: CN12.2 82.29,9.81 R42.2
$3N20318: length 7.2
  Top Layer w0.762: CN10.2 92.84,8.25 R40.2
$3N20331: length 10.4
  Top Layer w0.762: CN11.2 103.26,8.05 105.45,10.24 108.33,10.24 R46.2
$4N2340: length 13
  Top Layer w0.254: U37.1 64.51,18.07 65.19,18.75 65.19,24.43 64.56,25.06 62.27,25.06 61.96,25.37 R61.2
$4N2422: length 3.5
  Top Layer w0.254: U38.1 52.16,15.21 R63.1
$4N4574: length 22.4
  Top Layer w0.254: D4.1 42.14,12.86 43.64,14.37 ; R57.2 41.03,14.37 43.64,14.37 ; 42.53,20.08 43.88,20.08 44.42,19.54 44.42,14.6 R56.1 43.64,14.37
  Top Layer w0.762: CN14.2 41.91,11.22 D4.1
$4N4575: length 25.7
  Top Layer w0.254: 47.32,13.58 46.53,14.37 R56.2 45.69,15.97 v1(45.62,16.04) ; 47.32,13.58 D4.2 ; 47.32,13.58 48.03,14.29 49.44,14.29 R55.1 ; 42.53,18.81 40.68,18.81 v1(40.29,18.42)
  Top Layer w0.762: CN14.1 47.32,4.35 D4.2
  Bottom Layer w0.254: v1(45.62,16.04) 45.66,16.04 45.67,16.05 41,16.05 40.29,16.75 v1(40.29,18.42)
$4N5104: length 6.5
  Top Layer w0.254: U36.1 57.69,23.97 R59.2

## Copper pours and planes (outline as drawn; the poured copper is in the pictures)
+5V on Inner2: 22.79,58.07 30.15,58.07 30.15,27.8 22.79,27.8
+5V on Inner2: 22.79,33.02 121.42,33.02 121.42,25.94 22.79,25.94
+5V on Inner2: 3.36,59.96 112.31,59.96 112.31,57.03 3.36,57.03
GND on Top Layer: -1.02,56.49 123.28,56.49 124.93,58.14 124.93,30.91 123.15,29.13 30.02,29.13 30.02,8.36 -2.12,8.36 -2.56,8.8 -2.56,54.95
GND on Bottom Layer: 54.16,27.53 54.71,27.53 56.67,29.49 56.67,31.04 56.23,31.48 39.99,31.48 39.65,31.82 39.65,35.06 32.71,35.06 32.55,34.9 32.55,31.29 36.63,27.21 53.84,27.21
GND on Bottom Layer: -1.64,52.71 121.01,52.71 121.05,52.75 121.05,28.22 66.19,28.95 65.66,8.11 -1.55,8.11 -1.64,8.2
GND on Inner1: 16.29,56.3 114.43,56.3 114.43,51.96 16.29,51.96
GND on Inner1: 16.34,33.49 42.39,33.49 42.39,29.08 16.34,29.08
GND on Inner1: 74.52,33.25 114.11,33.25 114.11,28.66 74.52,28.66
GND on Inner1: 113.81,56.56 121.72,56.56 121.72,28.7 113.81,28.7
GND on Inner1: 0.36,56.36 16.34,56.36 16.34,8.47 0.36,8.47

Small or netless copper shapes (teardrops, artwork), in the pictures only: 778 on Top Layer, 94 on Bottom Layer

## Text on the board
Top Silkscreen Layer: RX | TX | S0 | S1 | SWDIO | SWCLK | 3.3V | GND | SDA1 | SCL1
